# EasyEDA Pro project 智能车.eprj, schematic 2路有刷驱动
Create Date: 2023-07-31; Page Name: P1; Project Name: 智能车; Schematic Name: 电机驱动; Update Date: 2023-12-06; Company: 嘉立创EDA; Drawed: JoinNico; Page Size: A4; Version: V1.1
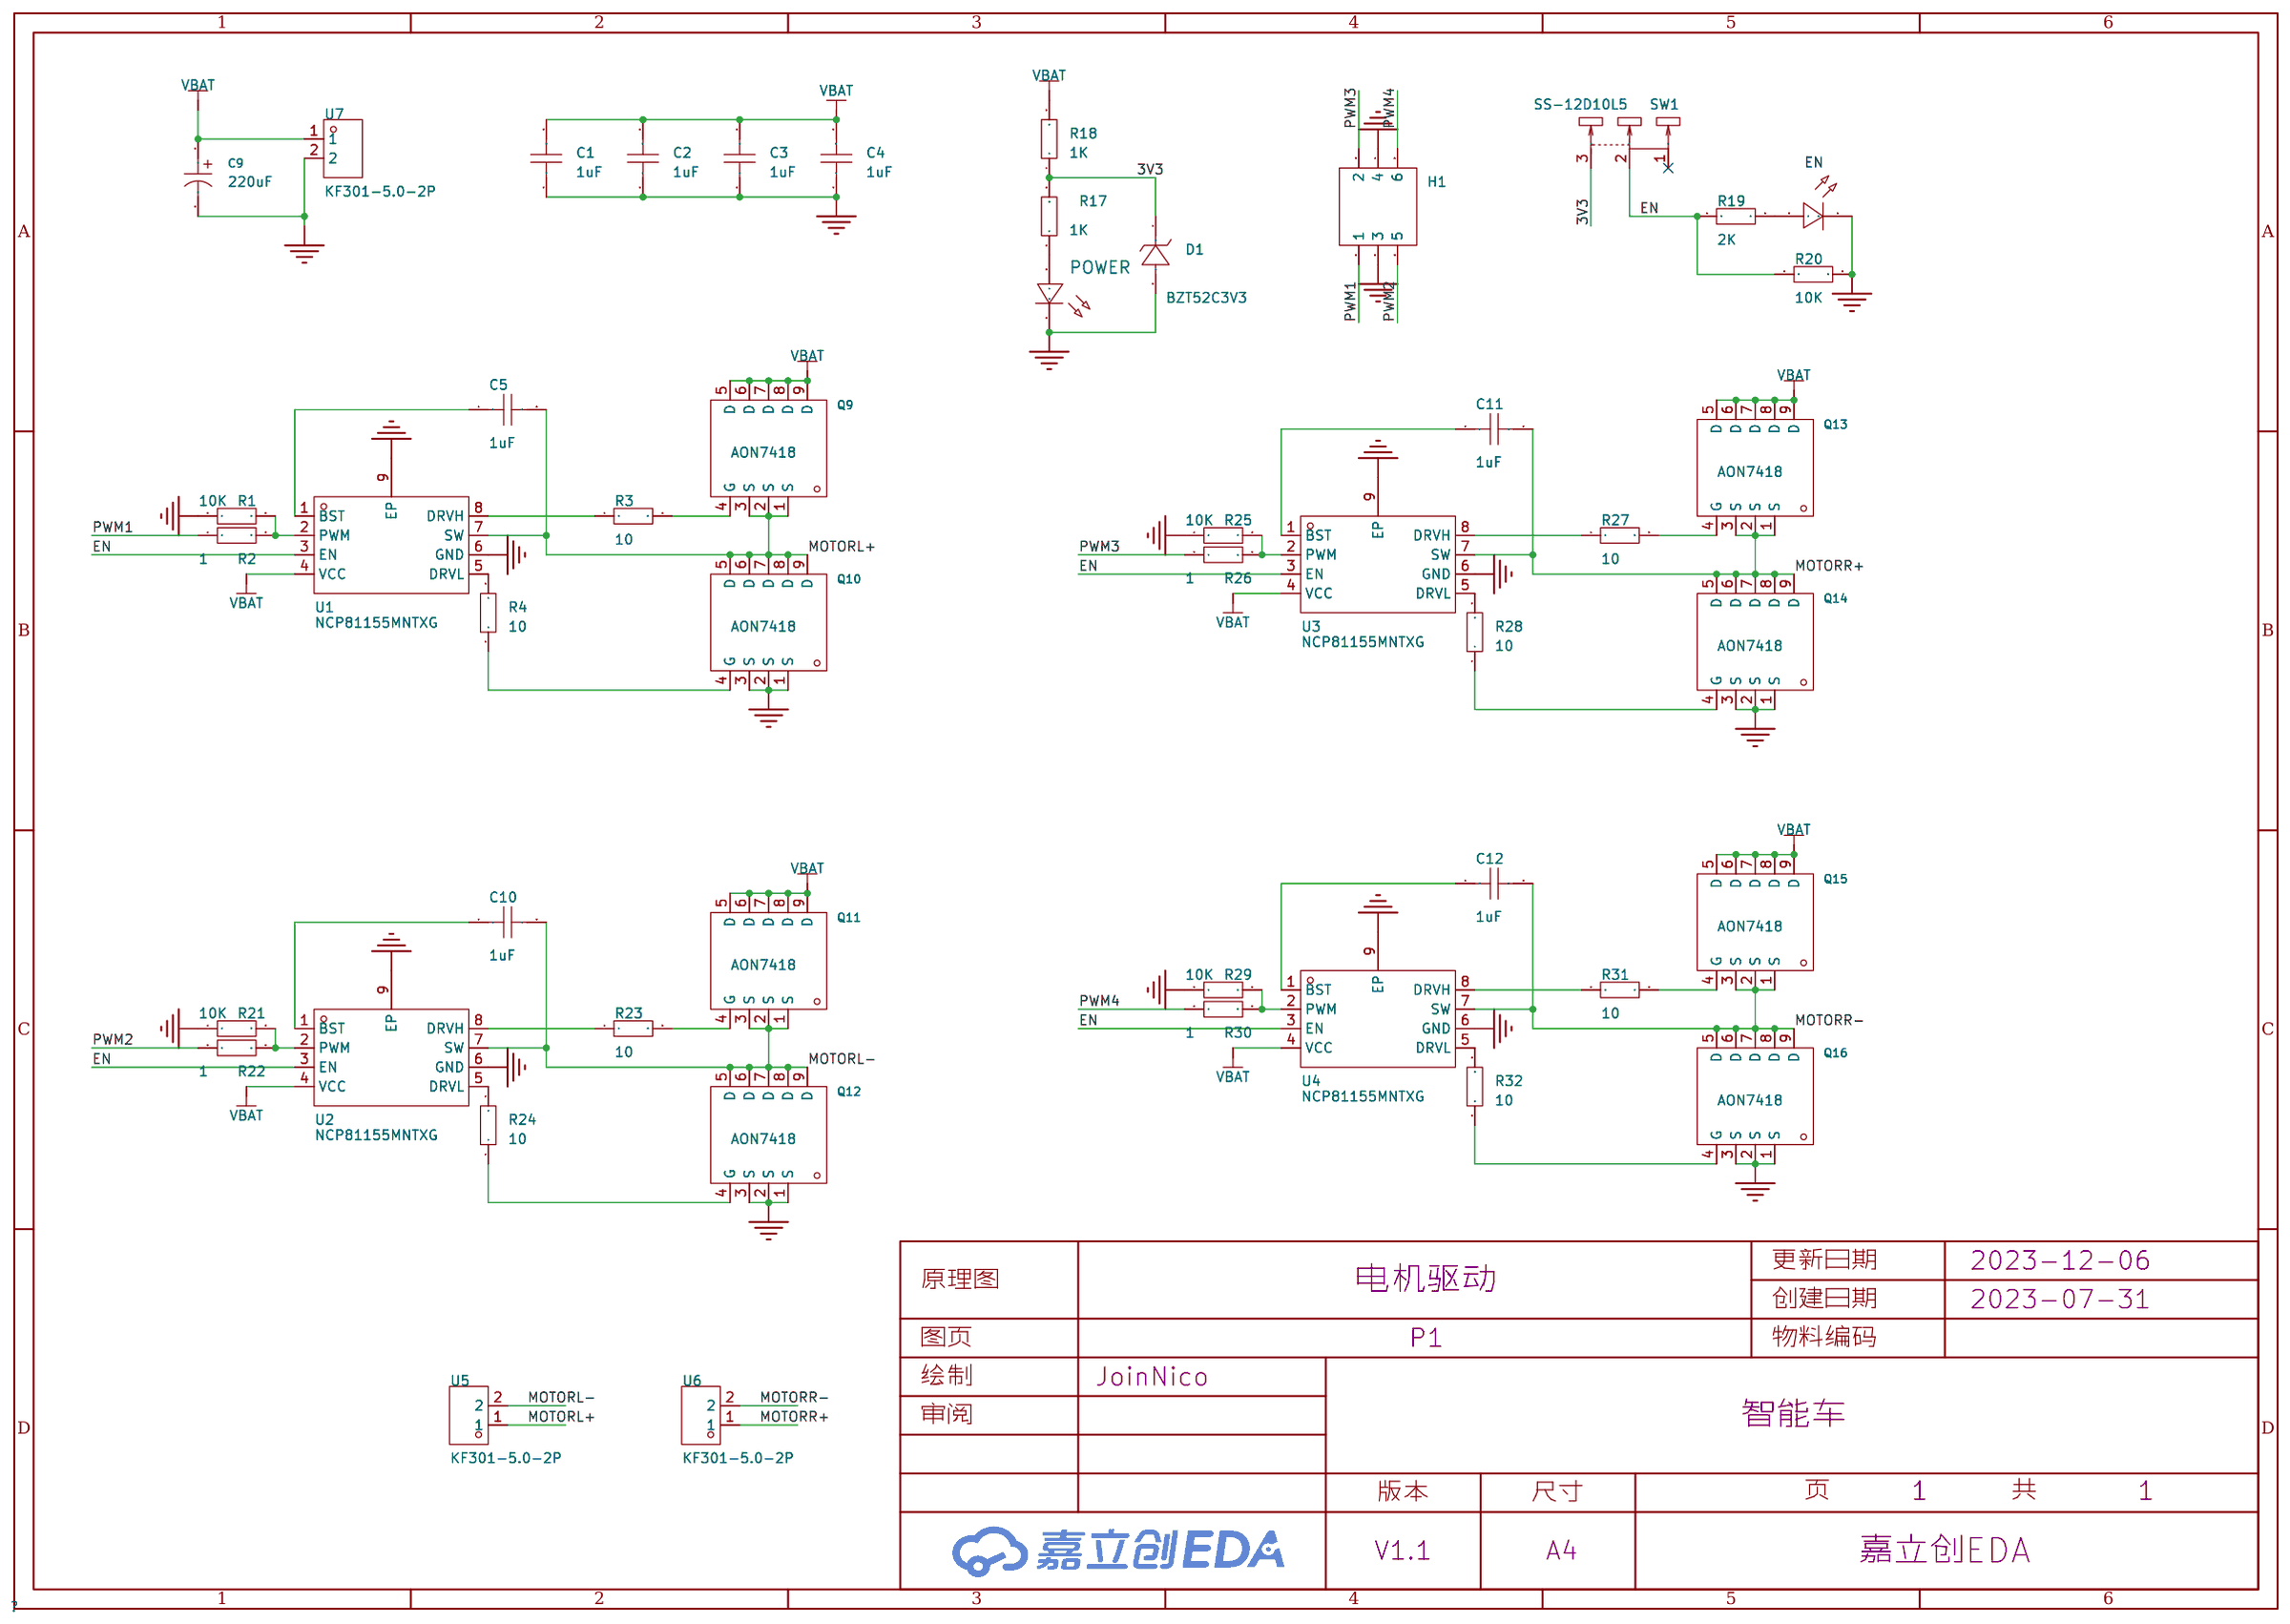
[diagram p1: schematic sheet]

## Parts
C1  1uF  [C0603]
C2  1uF  [C0603]
C3  1uF  [C0603]
C4  1uF  [C0603]
C5  1uF  [C0603]
C9  220uF  [CAP-SMD_BD8.0-L8.3-W8.3-LS9.3-FD]
C10  1uF  [C0603]
C11  1uF  [C0603]
C12  1uF  [C0603]
D1  BZT52C3V3  [SOD-123_L2.7-W1.7-LS3.8-RD]
EN  -  [LED_0603]
H1  -  [HDR-TH_6P-P2.54-V-R2-C3-S2.54_A2541WV-2X3P]
POWER  -  [LED_0603]
Q9  AON7418  [PDFN-8_L3.3-W3.3-P0.65-BL]
Q10  AON7418  [PDFN-8_L3.3-W3.3-P0.65-BL]
Q11  AON7418  [PDFN-8_L3.3-W3.3-P0.65-BL]
Q12  AON7418  [PDFN-8_L3.3-W3.3-P0.65-BL]
Q13  AON7418  [PDFN-8_L3.3-W3.3-P0.65-BL]
Q14  AON7418  [PDFN-8_L3.3-W3.3-P0.65-BL]
Q15  AON7418  [PDFN-8_L3.3-W3.3-P0.65-BL]
Q16  AON7418  [PDFN-8_L3.3-W3.3-P0.65-BL]
R1  10K  [R0603]
R2  1  [R0603]
R3  10  [R0603]
R4  10  [R0603]
R17  1K  [R0603]
R18  1K  [R0603]
R19  2K  [R0603]
R20  10K  [R0603]
R21  10K  [R0603]
R22  1  [R0603]
R23  10  [R0603]
R24  10  [R0603]
R25  10K  [R0603]
R26  1  [R0603]
R27  10  [R0603]
R28  10  [R0603]
R29  10K  [R0603]
R30  1  [R0603]
R31  10  [R0603]
R32  10  [R0603]
SW1  SS-12D10L5  [SW-TH_SS-12D10L5]
U1  NCP81155MNTXG  [DFN-8_L3.0-W3.0-P0.50-TL-EP]
U2  NCP81155MNTXG  [DFN-8_L3.0-W3.0-P0.50-TL-EP]
U3  NCP81155MNTXG  [DFN-8_L3.0-W3.0-P0.50-TL-EP]
U4  NCP81155MNTXG  [DFN-8_L3.0-W3.0-P0.50-TL-EP]
U5  KF301-5.0-2P  [CONN-TH_P5.00_KF301-5.0-2P]
U6  KF301-5.0-2P  [CONN-TH_P5.00_KF301-5.0-2P]
U7  KF301-5.0-2P  [CONN-TH_P5.00_KF301-5.0-2P]

## Library data of the parts
C1-C5 C10-C12 = CAP_0603: Supplier Footprint: 0603
C9 = RVT220UF35V67RV0024: 容值:220uF;精度:±20%;额定电压:35V;纹波电流:195mA@120Hz;等效串联电阻:-;; LCSC Part Name: 220uF ±20% 35V; Supplier Part: C2836441; Manufacturer: KNSCHA(科尼盛); Supplier Footprint: SMD,D8xL10.2mm; JLCPCB Part Class: Extended Part; Datasheet: https://atta.szlcsc.com/upload/public/pdf/source/20210528/C2836441_17B1F737CDEB8BC64E6C288AF923F1CC.pdf; Supplier: LCSC; Tolerance: ±20%; Rated Voltage: 35V; φD: 8mm; L: 10.2mm; Ripple Current: 195mA@120Hz; Lifetime @ Temp: 2000hrs@105℃; Operating Temperature: -55℃~+105℃
D1 = BZT52C3V3_C726990: 稳压值(标称值):3.3V;精度:-;功率:500mW;反向电流(Ir):5uA@1V;; LCSC Part Name: 3.3V 500mW; Supplier Part: C726990; Manufacturer: TWGMC(台湾迪嘉); Supplier Footprint: SOD-123; JLCPCB Part Class: Extended Part; Datasheet: https://atta.szlcsc.com/upload/public/pdf/source/20200825/C726987_AA6CB64B7861C942BF0EE5963BB1FA70.pdf; Supplier: LCSC; Zener Voltage (Nom): 3.3V; Power Dissipation: 500mW; Reverse Leakage Current (Ir): 5uA@1V
EN = LED_0603-G: Supplier Footprint: 0603
H1 = HDR-M_2.54_2x3: Supplier Part: C402781; Supplier Footprint: 插件,P=2.54mm
POWER = LED_0603-R: Supplier Footprint: 0603
Q9-Q16 = AON7418: 类型:N沟道;漏源电压(Vdss):30V;连续漏极电流(Id):46A;功率(Pd):6.2W;导通电阻(RDS(on)@Vgs,Id):1.7mΩ@10V,20A;; LCSC Part Name: N沟道 耐压:30V 电流:46A; Supplier Part: C74384; Manufacturer: AOS; Supplier Footprint: DFN-8(3x3); JLCPCB Part Class: 扩展库; Datasheet: https://atta.szlcsc.com/upload/public/pdf/source/20190807/C74384_449E04F421CDCCDE17205D9B23C0216A.pdf; Supplier: LCSC; Type: N沟道; Drain Source Voltage (Vdss): 30V; Continuous Drain Current (Id): 46A; Power Dissipation (Pd): 6.2W; Drain Source On Resistance (RDS(on)@Vgs,Id): 1.7mΩ@10V,20A; Gate Threshold Voltage (Vgs(th)@Id): 2.2V@250uA
R1-R4 R17-R32 = Res_0603: Supplier Footprint: 0603
SW1 = SS-12D10L5: 额定电流(DC):3A;额定电压(DC):125V;额定电流(AC):3A;额定电压(AC):125V;电路结构:单刀双掷;安装方式:直插;机械寿命:1万次;开关颜色:黑色;; LCSC Part Name: 柄长5mm 直插双档 滑动开关 大电流; Supplier Part: C319012; Manufacturer: XKB Connectivity(中国星坤); Supplier Footprint: 插件; JLCPCB Part Class: Extended Part; Datasheet: https://atta.szlcsc.com/upload/public/pdf/source/20211009/D6412F37AABE6F9459A6EE7FA4DAEADB.pdf; Supplier: LCSC; Current Rating (DC): 3A; Voltage Rating (DC): 125V; Current Rating (AC): 3A; Voltage Rating (AC): 125V; Circuit: 单刀双掷; Mounting Style: 直插; Mechanical Life: 1万次; Actuator Color: 黑色; Actuator Style: 矩形柱状; Pin Style: PC引脚; Operating Temperature: -40℃~+85℃; Switch Length: 13mm; Switch Width: 6.8mm; Switch Height: 6.4mm
U1-U4 = NCP81155MNTXG: 驱动配置:半桥;负载类型:MOSFET;电源电压:4.5V~13.2V;峰值灌电流:-;; Supplier Part: C173765; Manufacturer: onsemi(安森美); Supplier Footprint: DFN-8-EP(3x3); JLCPCB Part Class: 扩展库; Datasheet: https://atta.szlcsc.com/upload/public/pdf/source/20221020/7D519529A85A5CD96CBFD99E86ADE911.pdf; Supplier: LCSC; Driven Configuration: 半桥; Number of Drivers: 2; loadtype: MOSFET; Supply Voltage: 4.5V~13.2V; Rise Time: 16ns; Fall Time: 11ns; Operating Temperature: -40℃~+150℃@(Tj)
U5-U7 = KF301-5.0-2P: 间距:5mm;排数:1;每排PIN数:2;安装方式:直针;额定电流:17A;额定电压:250V;线规 - AWG:14~22;线规 - mm?:1.5;工作温度范围:-30℃~+120℃;颜色:蓝色;; LCSC Part Name: 5mm 排数:1 每排P数:2 直针 可拼接 铜 环保; Supplier Part: C474881; Manufacturer: KEFA(科发); Supplier Footprint: 直插,P=5mm; JLCPCB Part Class: Extended Part; Datasheet: https://atta.szlcsc.com/upload/public/pdf/source/20200115/C474881_883EFE2003339C40FD1BEEEFC9A18423.pdf; Supplier: LCSC; Pitch: 5mm; Number of Rows: 1; Number of PINs Per Row: 2; Mounting Style: 直针; Current Rating (Max): 17A; Voltage Rating (Max): 250V; Wire Gauge - AWG: 14~22; Wire Gauge - mm?: 1.5; Operating Temperature Range: -30℃~+120℃; Color: 蓝色

## Nets
3V3: D1.1(K) R17.2 R18.1 SW1.3
GND: C1.1 C2.1 C3.1 C4.1 C9.2 D1.2(A) EN.1(C) H1.3 H1.4 POWER.1(C) Q10.1(S) Q10.2(S) Q10.3(S) Q12.1(S) Q12.2(S) Q12.3(S) Q14.1(S) Q14.2(S) Q14.3(S) Q16.1(S) Q16.2(S) Q16.3(S) R1.1 R20.2 R21.1 R25.1 R29.1 U1.6(GND) U1.9(EP) U2.6(GND) U2.9(EP) U3.6(GND) U3.9(EP) U4.6(GND) U4.9(EP) U7.2
VBAT: C1.2 C2.2 C3.2 C4.2 C9.1 Q9.5(D) Q9.6(D) Q9.7(D) Q9.8(D) Q9.9(D) Q11.5(D) Q11.6(D) Q11.7(D) Q11.8(D) Q11.9(D) Q13.5(D) Q13.6(D) Q13.7(D) Q13.8(D) Q13.9(D) Q15.5(D) Q15.6(D) Q15.7(D) Q15.8(D) Q15.9(D) R18.2 U1.4(VCC) U2.4(VCC) U3.4(VCC) U4.4(VCC) U7.1
EN: R19.1 R20.1 SW1.2 U1.3(EN) U2.3(EN) U3.3(EN) U4.3(EN)
MOTORL+: C5.2 Q9.1(S) Q9.2(S) Q9.3(S) Q10.5(D) Q10.6(D) Q10.7(D) Q10.8(D) Q10.9(D) U1.7(SW) U5.1
MOTORL-: C10.2 Q11.1(S) Q11.2(S) Q11.3(S) Q12.5(D) Q12.6(D) Q12.7(D) Q12.8(D) Q12.9(D) U2.7(SW) U5.2
MOTORR+: C11.2 Q13.1(S) Q13.2(S) Q13.3(S) Q14.5(D) Q14.6(D) Q14.7(D) Q14.8(D) Q14.9(D) U3.7(SW) U6.1
MOTORR-: C12.2 Q15.1(S) Q15.2(S) Q15.3(S) Q16.5(D) Q16.6(D) Q16.7(D) Q16.8(D) Q16.9(D) U4.7(SW) U6.2
PWM1: H1.1 R2.1
PWM2: H1.5 R22.1
PWM3: H1.2 R26.1
PWM4: H1.6 R30.1
$1N1614: R1.2 R2.2 U1.2(PWM)
$1N1615: C5.1 U1.1(BST)
$1N1617: R3.1 U1.8(DRVH)
$1N1618: R4.2 U1.5(DRVL)
$1N4435: EN.2(A) R19.2
$1N4625: POWER.2(A) R17.1
$1N5255: Q9.4(G) R3.2
$1N5368: Q10.4(G) R4.1
$1N5752: R21.2 R22.2 U2.2(PWM)
$1N5753: C10.1 U2.1(BST)
$1N5755: R23.1 U2.8(DRVH)
$1N5756: R24.2 U2.5(DRVL)
$1N5762: Q11.4(G) R23.2
$1N5777: Q12.4(G) R24.1
$1N6155: R25.2 R26.2 U3.2(PWM)
$1N6156: C11.1 U3.1(BST)
$1N6158: R27.1 U3.8(DRVH)
$1N6159: R28.2 U3.5(DRVL)
$1N6165: Q13.4(G) R27.2
$1N6180: Q14.4(G) R28.1
$1N6558: R29.2 R30.2 U4.2(PWM)
$1N6559: C12.1 U4.1(BST)
$1N6561: R31.1 U4.8(DRVH)
$1N6562: R32.2 U4.5(DRVL)
$1N6568: Q15.4(G) R31.2
$1N6583: Q16.4(G) R32.1

Not connected (* = marked no-connect by the designer): SW1 1*
